# Altium schematic sheet CoinCraftA1.SchDoc (part 1 of 2)
size A0
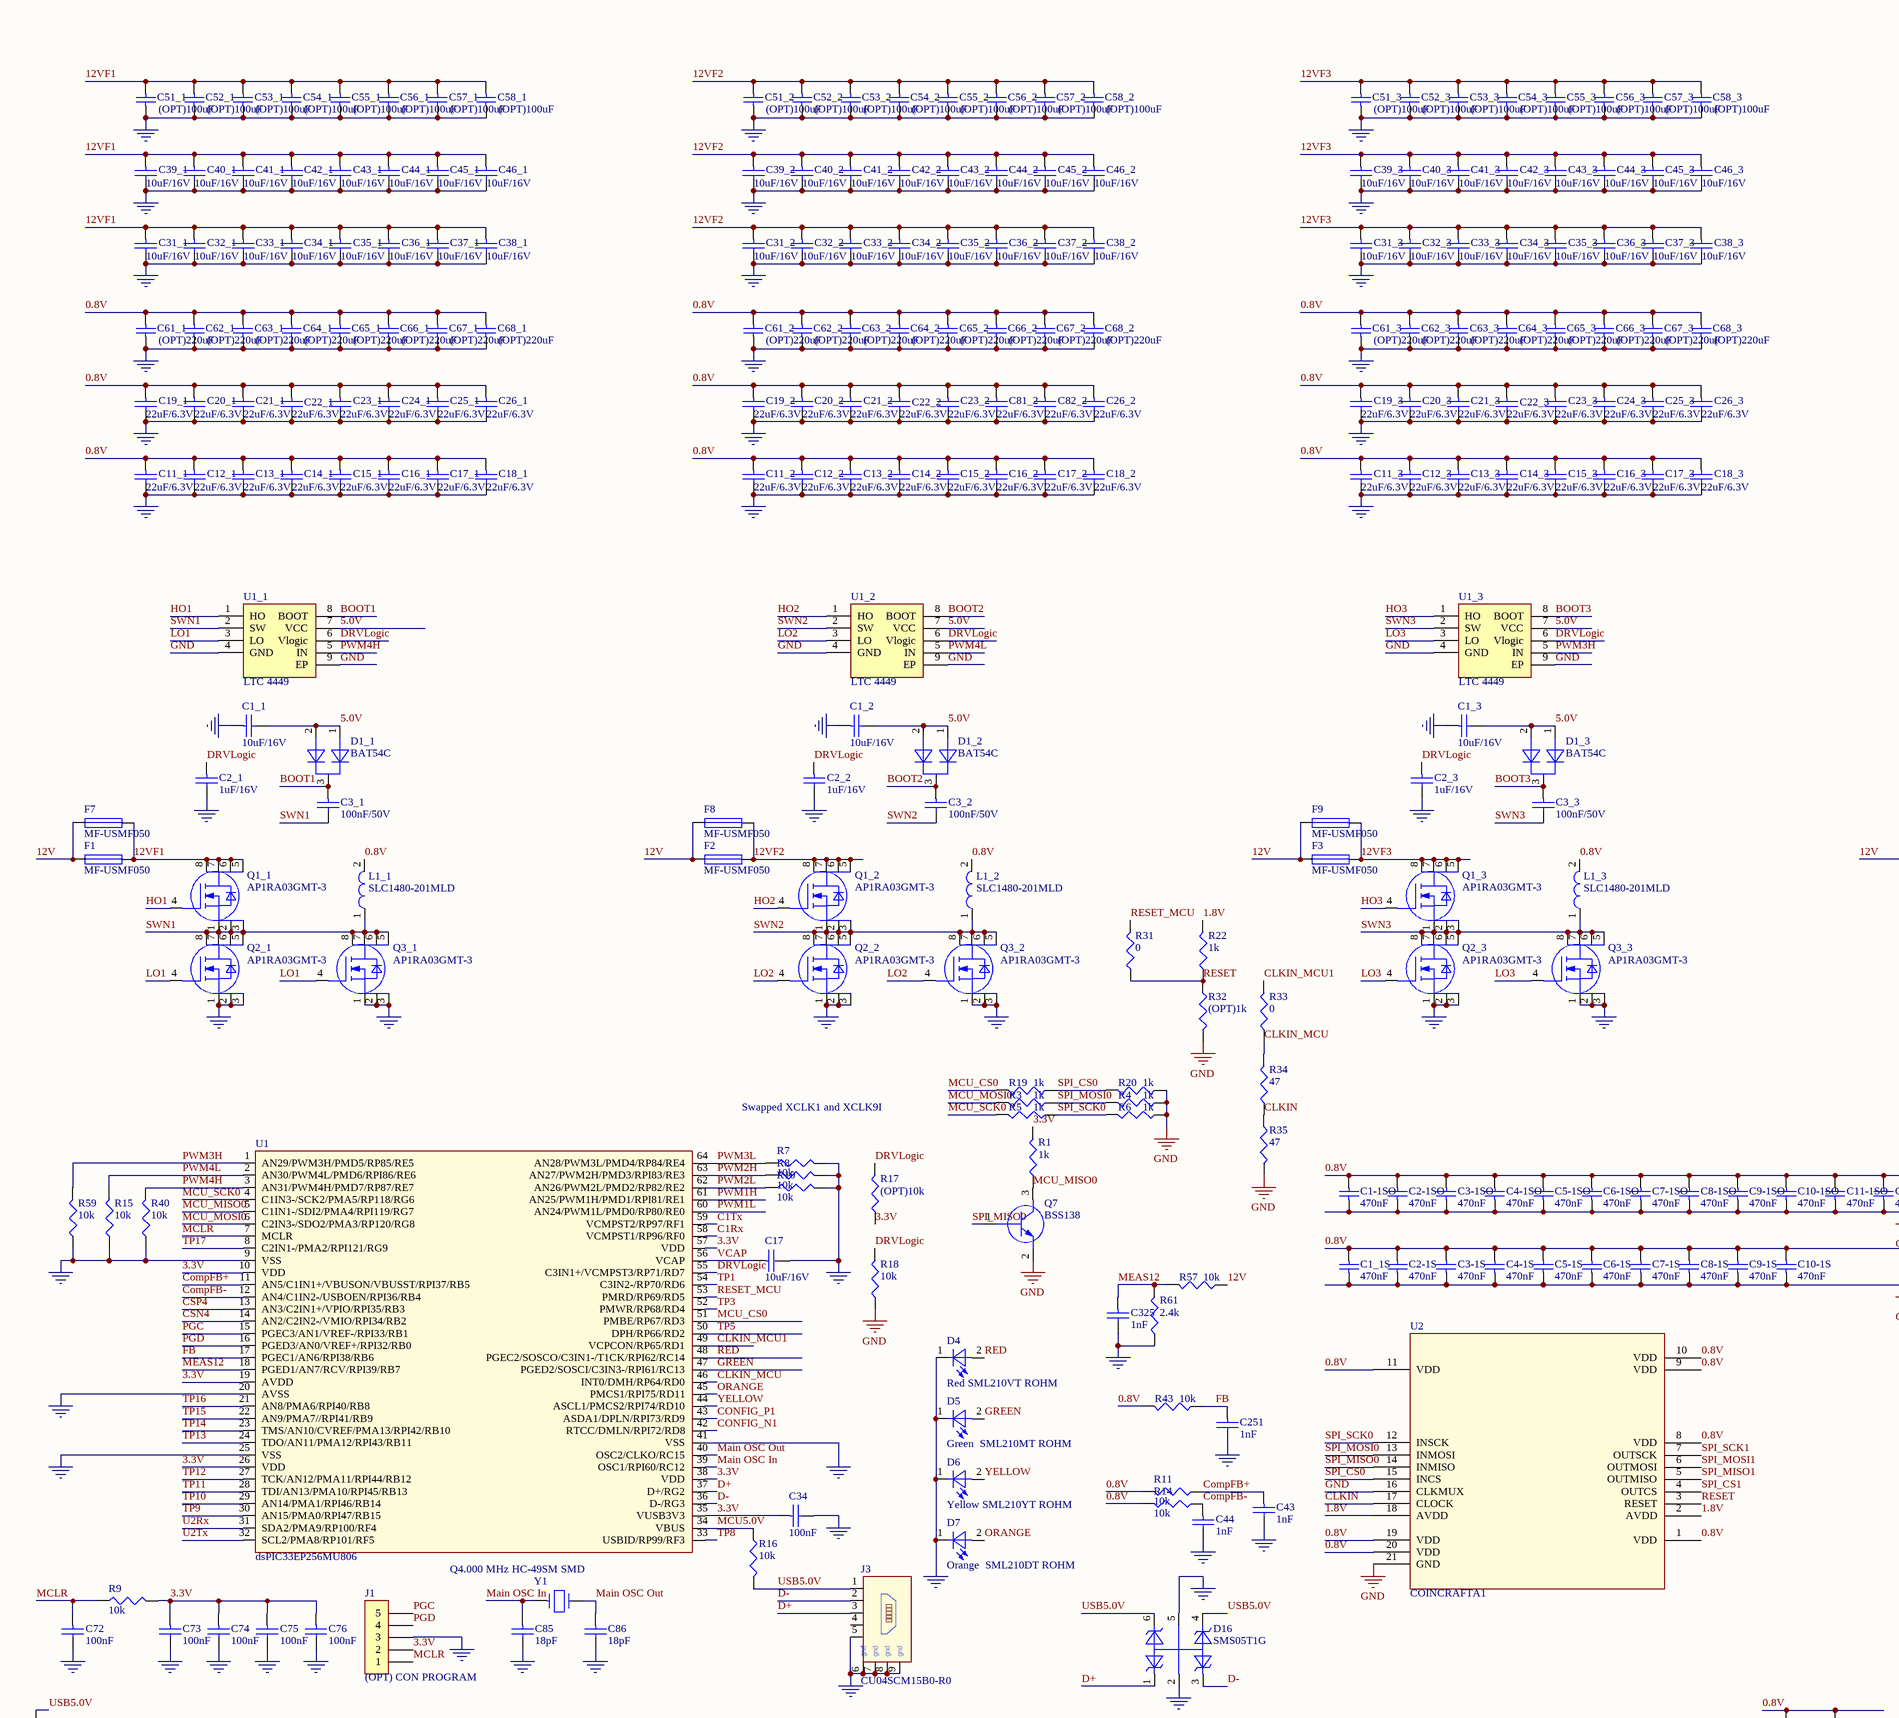
[diagram p0: CoinCraftA1.SchDoc, top left]
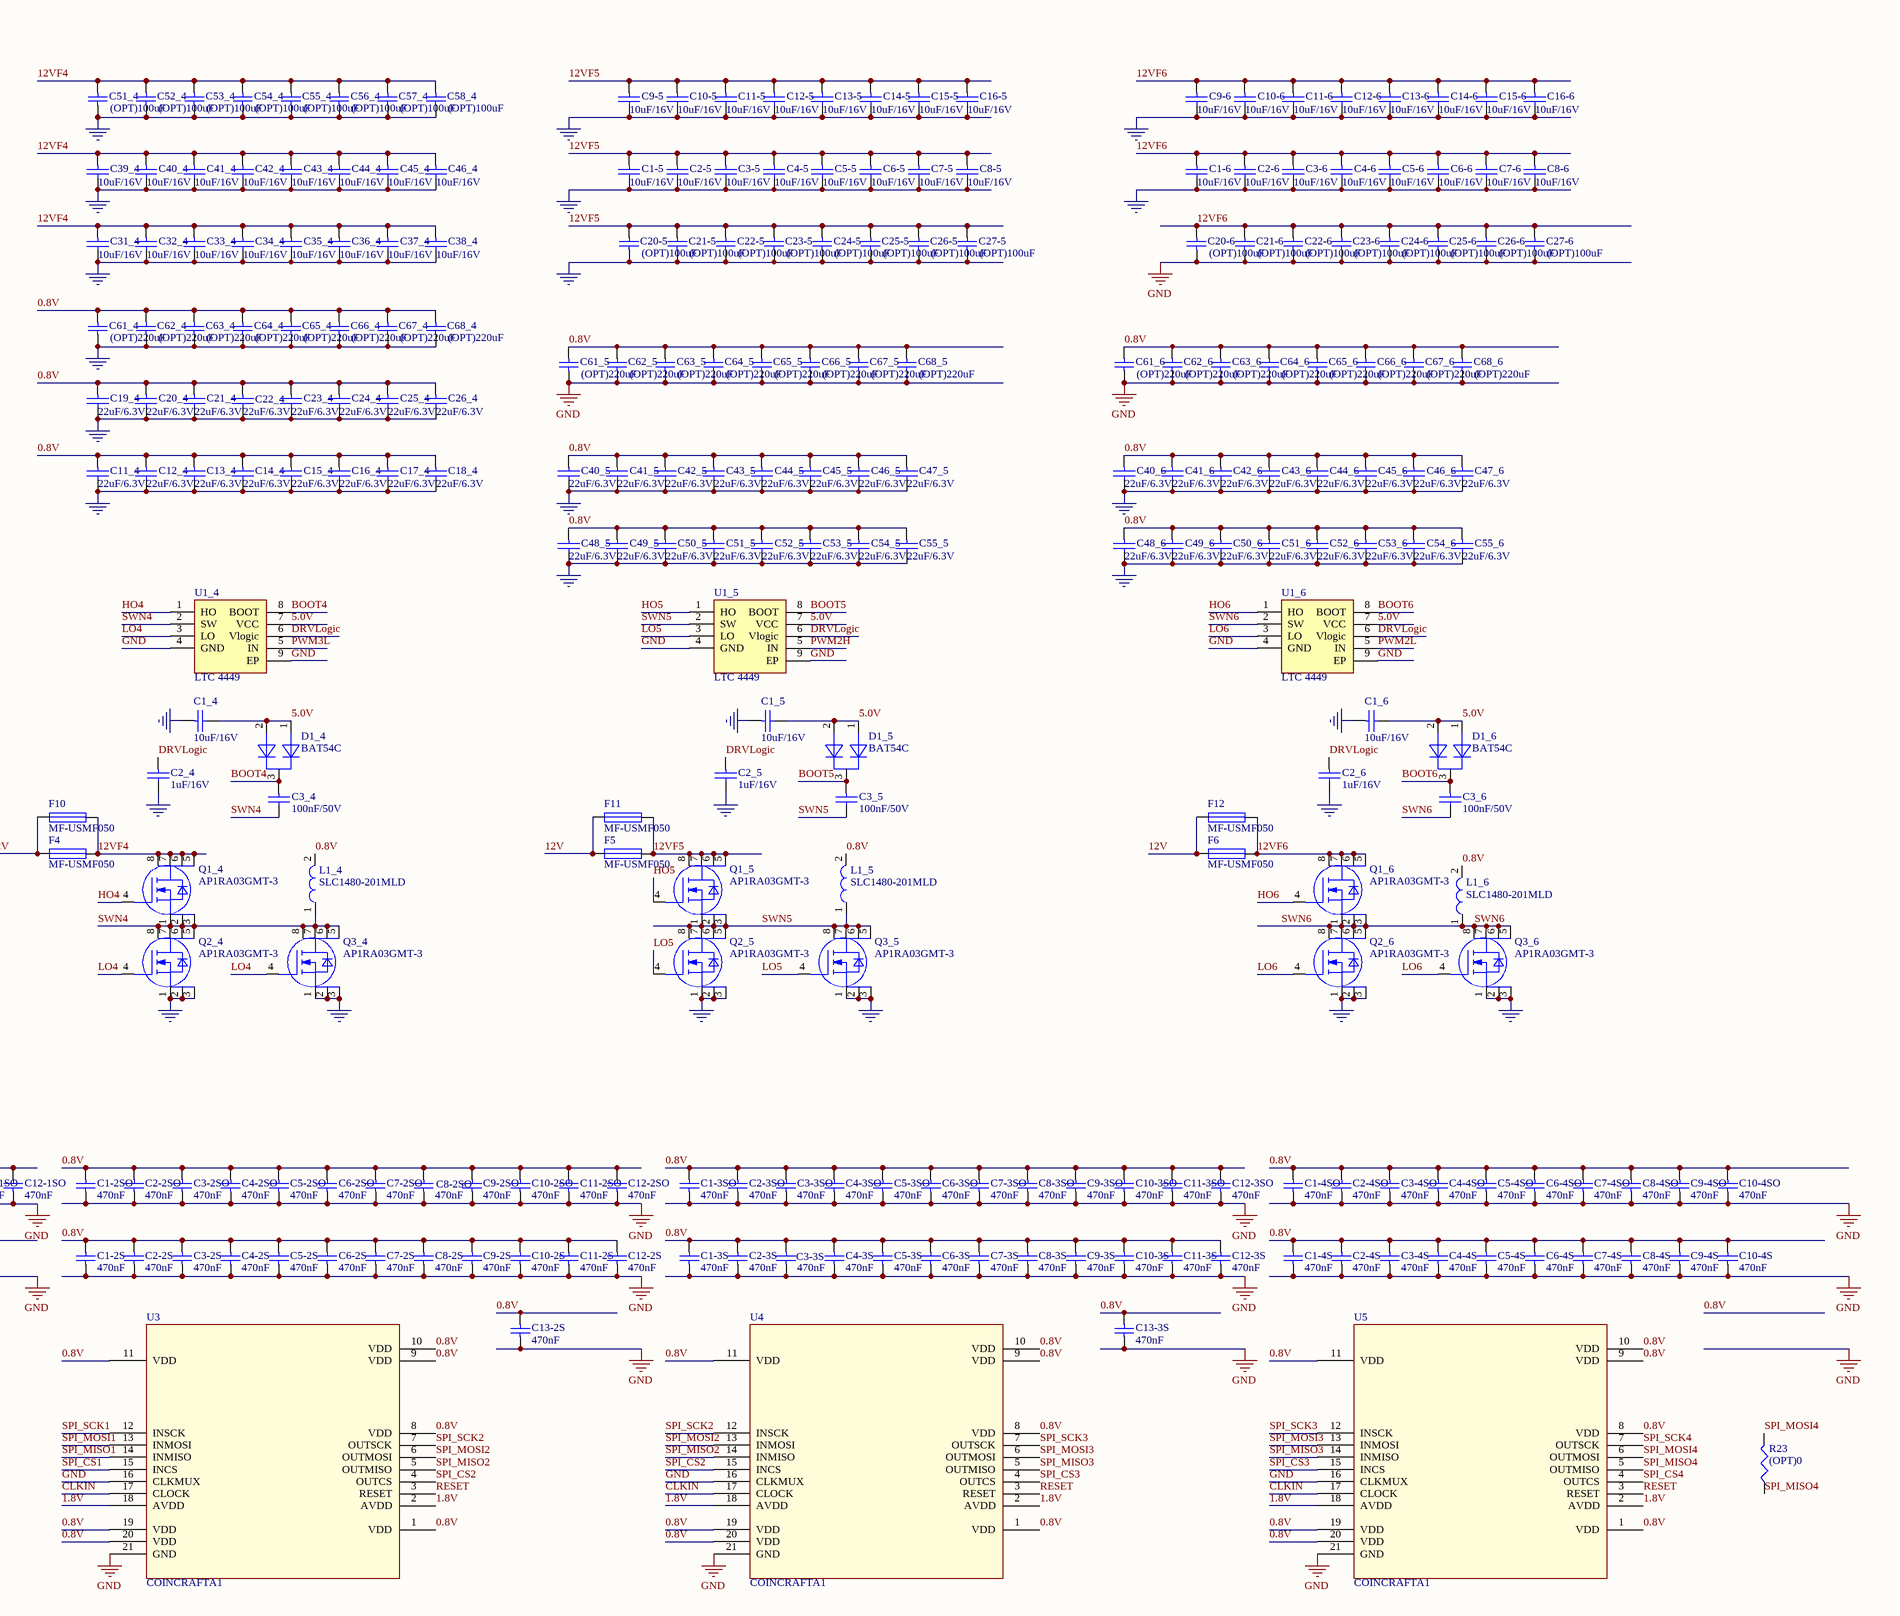
[diagram p1: CoinCraftA1.SchDoc, top middle]
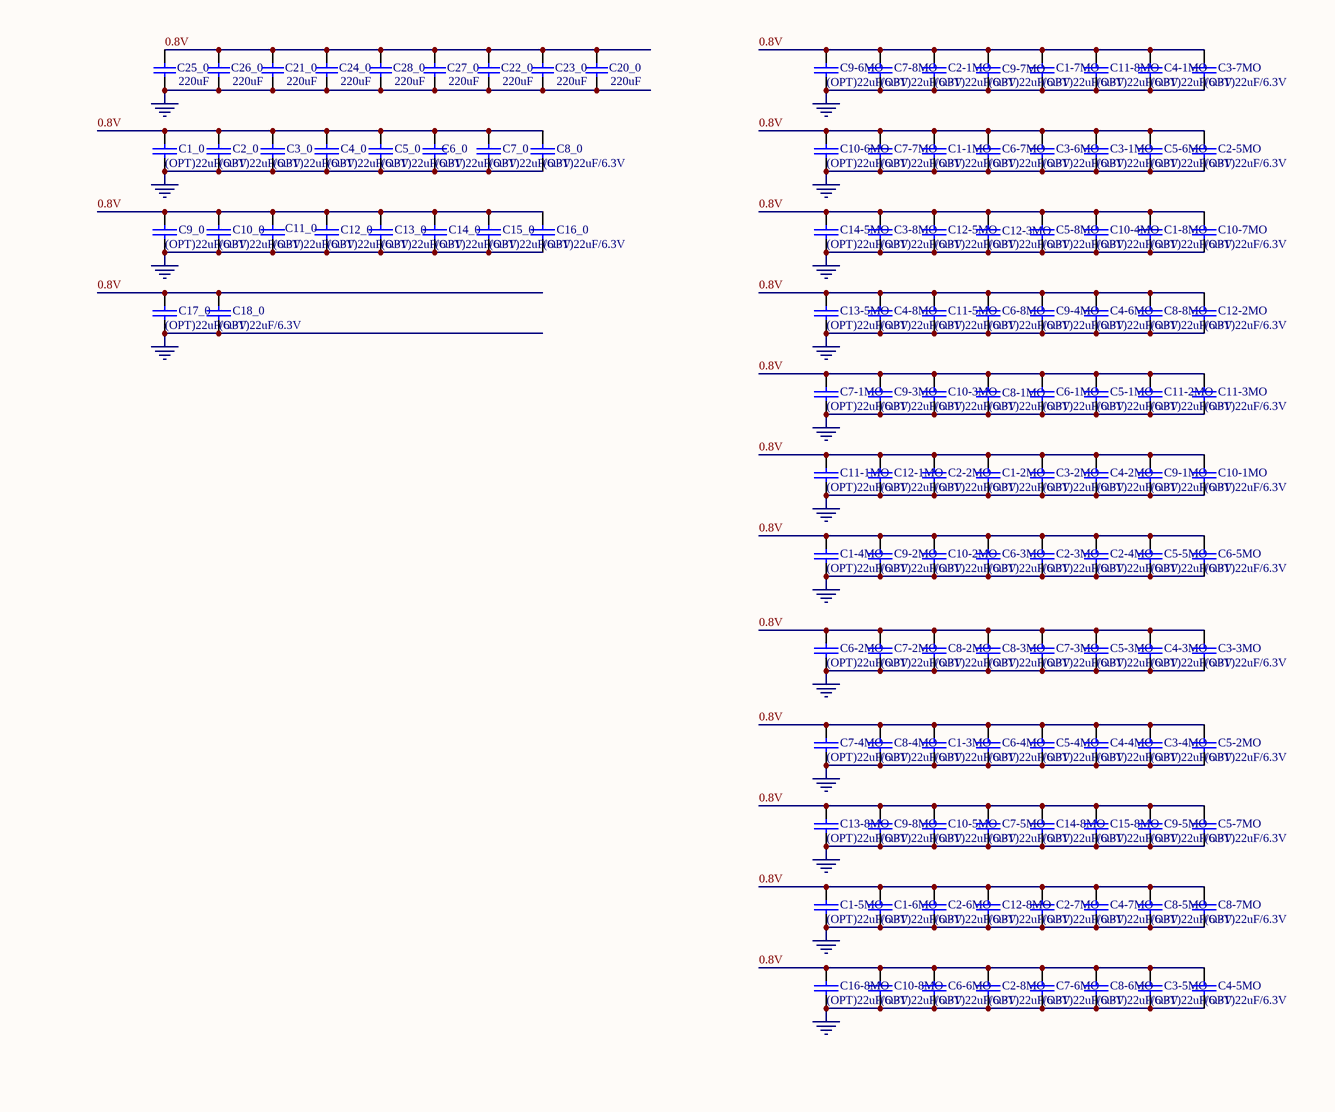
[diagram p2: CoinCraftA1.SchDoc, top right]
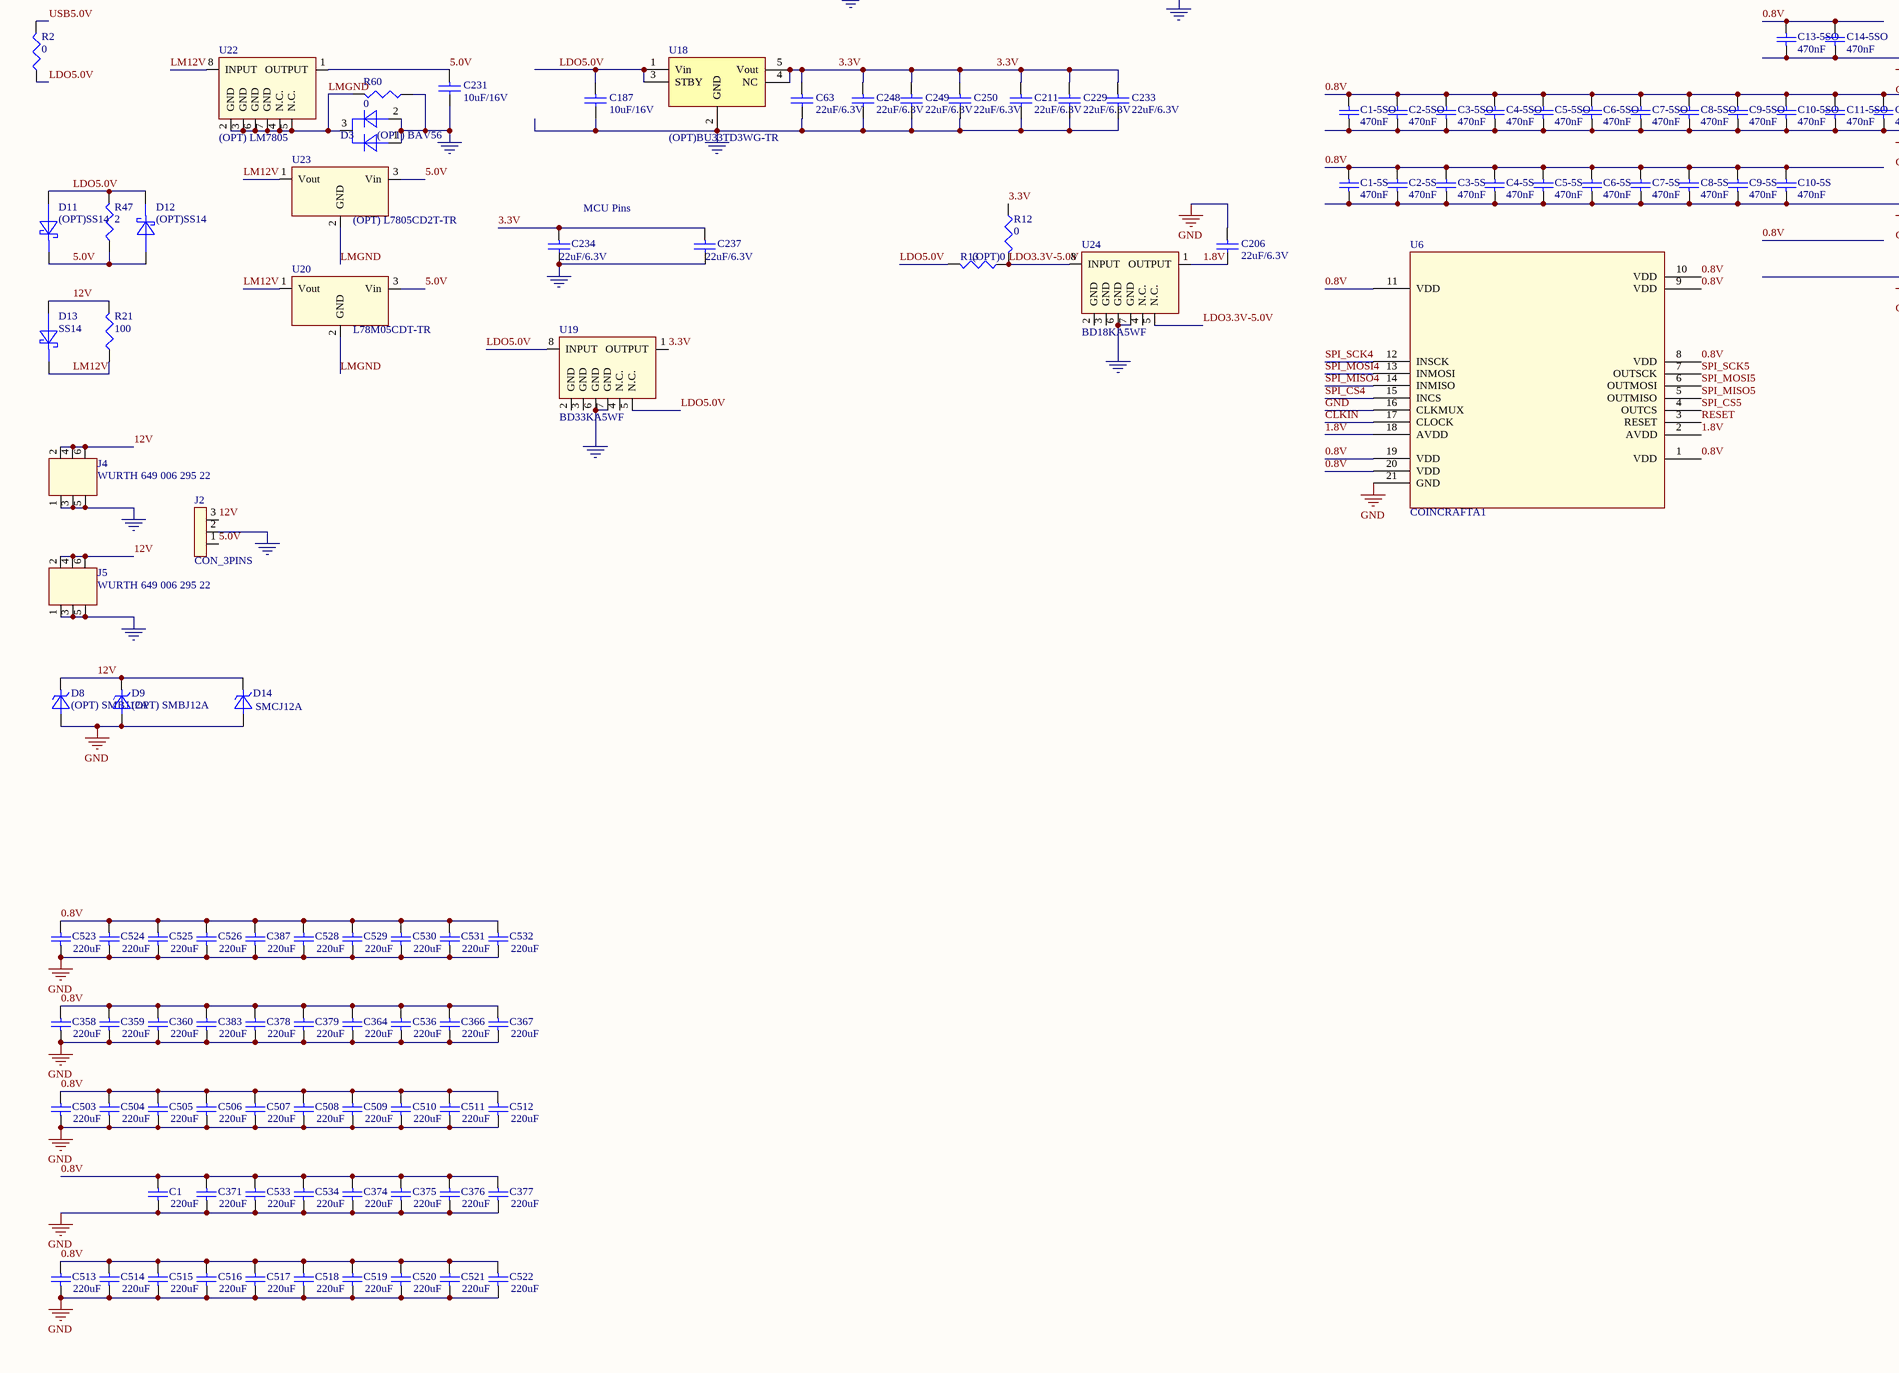
[diagram p3: CoinCraftA1.SchDoc, bottom left]
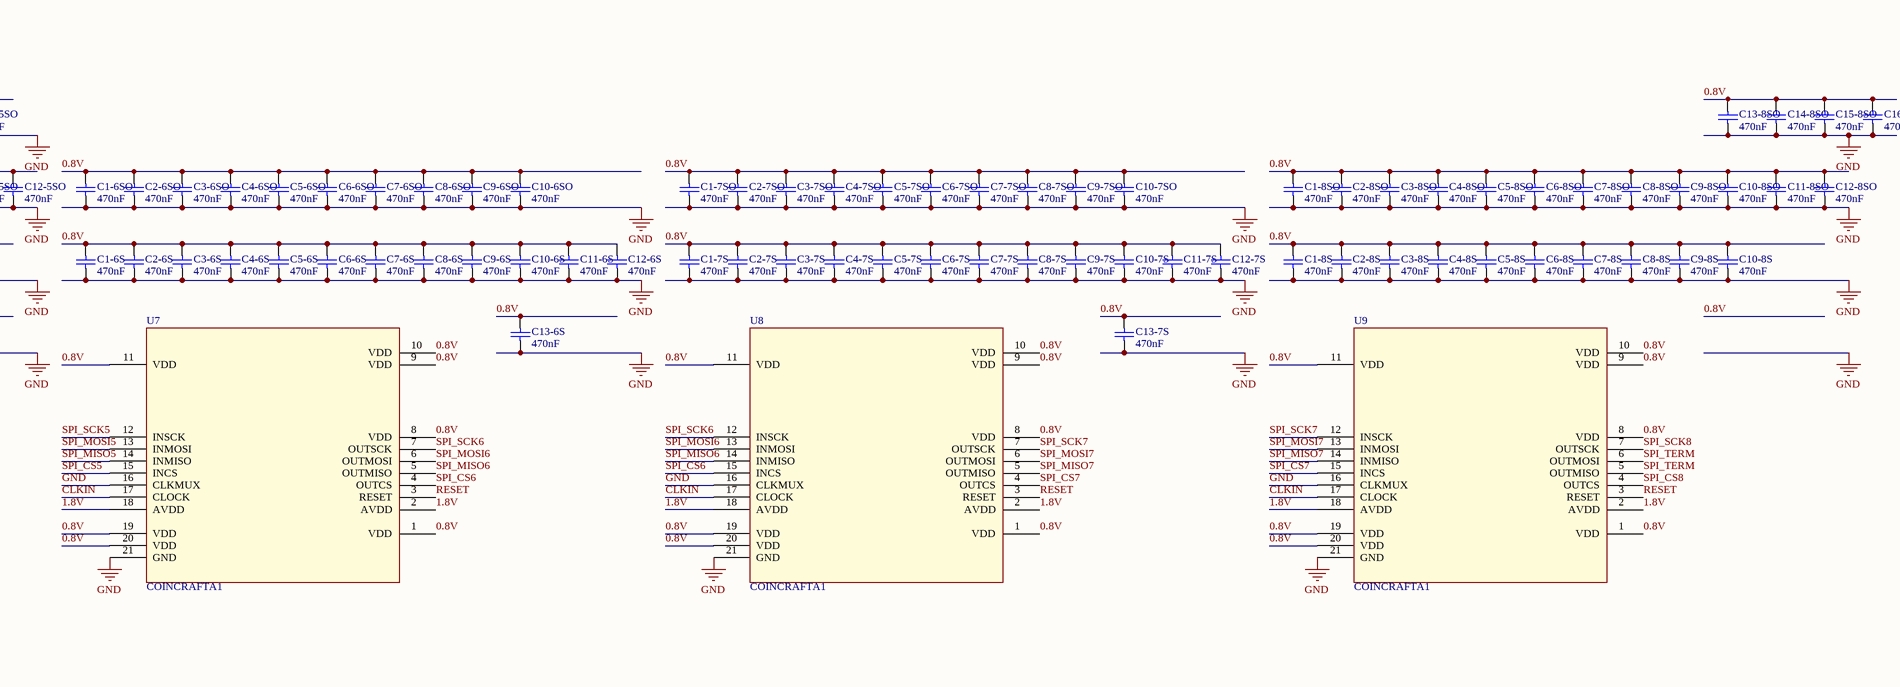
[diagram p4: CoinCraftA1.SchDoc, bottom middle]
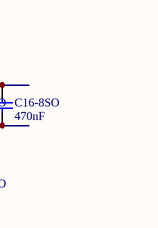
[diagram p5: CoinCraftA1.SchDoc, bottom right]

## Parts
C1  220uF  [SMD_1210_CAPC3225X279N]
C1-1MO  (OPT)22uF/6.3V  [SMD_0805_CAPC2012X145N]
C1-1SO  value 470nF  [SMD_0603_CAPC1608X80N]  (hidden comment: (OPT) 470nF)
C1-2MO  (OPT)22uF/6.3V  [SMD_0805_CAPC2012X145N]
C1-2S  470nF  [SMD_0603_CAPC1608X80N]
C1-2SO  value 470nF  [SMD_0603_CAPC1608X80N]  (hidden comment: (OPT) 470nF)
C1-3MO  (OPT)22uF/6.3V  [SMD_0805_CAPC2012X145N]
C1-3S  470nF  [SMD_0603_CAPC1608X80N]
C1-3SO  value 470nF  [SMD_0603_CAPC1608X80N]  (hidden comment: (OPT) 470nF)
C1-4MO  (OPT)22uF/6.3V  [SMD_0805_CAPC2012X145N]
C1-4S  470nF  [SMD_0603_CAPC1608X80N]
C1-4SO  value 470nF  [SMD_0603_CAPC1608X80N]  (hidden comment: (OPT) 470nF)
C1-5  10uF/16V  [SMD_0805_CAPC2012X145N]
C1-5MO  (OPT)22uF/6.3V  [SMD_0805_CAPC2012X145N]
C1-5S  470nF  [SMD_0603_CAPC1608X80N]
C1-5SO  value 470nF  [SMD_0603_CAPC1608X80N]  (hidden comment: (OPT) 470nF)
C1-6  10uF/16V  [SMD_0805_CAPC2012X145N]
C1-6MO  (OPT)22uF/6.3V  [SMD_0805_CAPC2012X145N]
C1-6S  470nF  [SMD_0603_CAPC1608X80N]
C1-6SO  value 470nF  [SMD_0603_CAPC1608X80N]  (hidden comment: (OPT) 470nF)
C1-7MO  (OPT)22uF/6.3V  [SMD_0805_CAPC2012X145N]
C1-7S  470nF  [SMD_0603_CAPC1608X80N]
C1-7SO  value 470nF  [SMD_0603_CAPC1608X80N]  (hidden comment: (OPT) 470nF)
C1-8MO  (OPT)22uF/6.3V  [SMD_0805_CAPC2012X145N]
C1-8S  470nF  [SMD_0603_CAPC1608X80N]
C1-8SO  value 470nF  [SMD_0603_CAPC1608X80N]  (hidden comment: (OPT) 470nF)
C1_0  (OPT)22uF/6.3V  [SMD_0805_CAPC2012X145N]
C1_1  10uF/16V  [SMD_0805_CAPC2012X145N]
C1_1S  470nF  [SMD_0603_CAPC1608X80N]
C1_2  10uF/16V  [SMD_0805_CAPC2012X145N]
C1_3  10uF/16V  [SMD_0805_CAPC2012X145N]
C1_4  10uF/16V  [SMD_0805_CAPC2012X145N]
C1_5  10uF/16V  [SMD_0805_CAPC2012X145N]
C1_6  10uF/16V  [SMD_0805_CAPC2012X145N]
C2-1MO  (OPT)22uF/6.3V  [SMD_0805_CAPC2012X145N]
C2-1S  470nF  [SMD_0603_CAPC1608X80N]
C2-1SO  value 470nF  [SMD_0603_CAPC1608X80N]  (hidden comment: (OPT) 470nF)
C2-2MO  (OPT)22uF/6.3V  [SMD_0805_CAPC2012X145N]
C2-2S  470nF  [SMD_0603_CAPC1608X80N]
C2-2SO  value 470nF  [SMD_0603_CAPC1608X80N]  (hidden comment: (OPT) 470nF)
C2-3MO  (OPT)22uF/6.3V  [SMD_0805_CAPC2012X145N]
C2-3S  470nF  [SMD_0603_CAPC1608X80N]
C2-3SO  value 470nF  [SMD_0603_CAPC1608X80N]  (hidden comment: (OPT) 470nF)
C2-4MO  (OPT)22uF/6.3V  [SMD_0805_CAPC2012X145N]
C2-4S  470nF  [SMD_0603_CAPC1608X80N]
C2-4SO  value 470nF  [SMD_0603_CAPC1608X80N]  (hidden comment: (OPT) 470nF)
C2-5  10uF/16V  [SMD_0805_CAPC2012X145N]
C2-5MO  (OPT)22uF/6.3V  [SMD_0805_CAPC2012X145N]
C2-5S  470nF  [SMD_0603_CAPC1608X80N]
C2-5SO  value 470nF  [SMD_0603_CAPC1608X80N]  (hidden comment: (OPT) 470nF)
C2-6  10uF/16V  [SMD_0805_CAPC2012X145N]
C2-6MO  (OPT)22uF/6.3V  [SMD_0805_CAPC2012X145N]
C2-6S  470nF  [SMD_0603_CAPC1608X80N]
C2-6SO  value 470nF  [SMD_0603_CAPC1608X80N]  (hidden comment: (OPT) 470nF)
C2-7MO  (OPT)22uF/6.3V  [SMD_0805_CAPC2012X145N]
C2-7S  470nF  [SMD_0603_CAPC1608X80N]
C2-7SO  value 470nF  [SMD_0603_CAPC1608X80N]  (hidden comment: (OPT) 470nF)
C2-8MO  (OPT)22uF/6.3V  [SMD_0805_CAPC2012X145N]
C2-8S  470nF  [SMD_0603_CAPC1608X80N]
C2-8SO  value 470nF  [SMD_0603_CAPC1608X80N]  (hidden comment: (OPT) 470nF)
C2_0  (OPT)22uF/6.3V  [SMD_0805_CAPC2012X145N]
C2_1  1uF/16V  [SMD_0805_CAPC2012X145N]
C2_2  1uF/16V  [SMD_0805_CAPC2012X145N]
C2_3  1uF/16V  [SMD_0805_CAPC2012X145N]
C2_4  1uF/16V  [SMD_0805_CAPC2012X145N]
C2_5  1uF/16V  [SMD_0805_CAPC2012X145N]
C2_6  1uF/16V  [SMD_0805_CAPC2012X145N]
C3-1MO  (OPT)22uF/6.3V  [SMD_0805_CAPC2012X145N]
C3-1S  470nF  [SMD_0603_CAPC1608X80N]
C3-1SO  value 470nF  [SMD_0603_CAPC1608X80N]  (hidden comment: (OPT) 470nF)
C3-2MO  (OPT)22uF/6.3V  [SMD_0805_CAPC2012X145N]
C3-2S  470nF  [SMD_0603_CAPC1608X80N]
C3-2SO  value 470nF  [SMD_0603_CAPC1608X80N]  (hidden comment: (OPT) 470nF)
C3-3MO  (OPT)22uF/6.3V  [SMD_0805_CAPC2012X145N]
C3-3S  470nF  [SMD_0603_CAPC1608X80N]
C3-3SO  value 470nF  [SMD_0603_CAPC1608X80N]  (hidden comment: (OPT) 470nF)
C3-4MO  (OPT)22uF/6.3V  [SMD_0805_CAPC2012X145N]
C3-4S  470nF  [SMD_0603_CAPC1608X80N]
C3-4SO  value 470nF  [SMD_0603_CAPC1608X80N]  (hidden comment: (OPT) 470nF)
C3-5  10uF/16V  [SMD_0805_CAPC2012X145N]
C3-5MO  (OPT)22uF/6.3V  [SMD_0805_CAPC2012X145N]
C3-5S  470nF  [SMD_0603_CAPC1608X80N]
C3-5SO  value 470nF  [SMD_0603_CAPC1608X80N]  (hidden comment: (OPT) 470nF)
C3-6  10uF/16V  [SMD_0805_CAPC2012X145N]
C3-6MO  (OPT)22uF/6.3V  [SMD_0805_CAPC2012X145N]
C3-6S  470nF  [SMD_0603_CAPC1608X80N]
C3-6SO  value 470nF  [SMD_0603_CAPC1608X80N]  (hidden comment: (OPT) 470nF)
C3-7MO  (OPT)22uF/6.3V  [SMD_0805_CAPC2012X145N]
C3-7S  470nF  [SMD_0603_CAPC1608X80N]
C3-7SO  value 470nF  [SMD_0603_CAPC1608X80N]  (hidden comment: (OPT) 470nF)
C3-8MO  (OPT)22uF/6.3V  [SMD_0805_CAPC2012X145N]
C3-8S  470nF  [SMD_0603_CAPC1608X80N]
C3-8SO  value 470nF  [SMD_0603_CAPC1608X80N]  (hidden comment: (OPT) 470nF)
C3_0  (OPT)22uF/6.3V  [SMD_0805_CAPC2012X145N]
C3_1  100nF/50V  [SMD_0805_CAPC2012X145N]
C3_2  100nF/50V  [SMD_0805_CAPC2012X145N]
C3_3  100nF/50V  [SMD_0805_CAPC2012X145N]
C3_4  100nF/50V  [SMD_0805_CAPC2012X145N]
C3_5  100nF/50V  [SMD_0805_CAPC2012X145N]
C3_6  100nF/50V  [SMD_0805_CAPC2012X145N]
C4-1MO  (OPT)22uF/6.3V  [SMD_0805_CAPC2012X145N]
C4-1S  470nF  [SMD_0603_CAPC1608X80N]
C4-1SO  value 470nF  [SMD_0603_CAPC1608X80N]  (hidden comment: (OPT) 470nF)
C4-2MO  (OPT)22uF/6.3V  [SMD_0805_CAPC2012X145N]
C4-2S  470nF  [SMD_0603_CAPC1608X80N]
C4-2SO  value 470nF  [SMD_0603_CAPC1608X80N]  (hidden comment: (OPT) 470nF)
C4-3MO  (OPT)22uF/6.3V  [SMD_0805_CAPC2012X145N]
C4-3S  470nF  [SMD_0603_CAPC1608X80N]
C4-3SO  value 470nF  [SMD_0603_CAPC1608X80N]  (hidden comment: (OPT) 470nF)
C4-4MO  (OPT)22uF/6.3V  [SMD_0805_CAPC2012X145N]
C4-4S  470nF  [SMD_0603_CAPC1608X80N]
C4-4SO  value 470nF  [SMD_0603_CAPC1608X80N]  (hidden comment: (OPT) 470nF)
C4-5  10uF/16V  [SMD_0805_CAPC2012X145N]
C4-5MO  (OPT)22uF/6.3V  [SMD_0805_CAPC2012X145N]
C4-5S  470nF  [SMD_0603_CAPC1608X80N]
C4-5SO  value 470nF  [SMD_0603_CAPC1608X80N]  (hidden comment: (OPT) 470nF)
C4-6  10uF/16V  [SMD_0805_CAPC2012X145N]
C4-6MO  (OPT)22uF/6.3V  [SMD_0805_CAPC2012X145N]
C4-6S  470nF  [SMD_0603_CAPC1608X80N]
C4-6SO  value 470nF  [SMD_0603_CAPC1608X80N]  (hidden comment: (OPT) 470nF)
C4-7MO  (OPT)22uF/6.3V  [SMD_0805_CAPC2012X145N]
C4-7S  470nF  [SMD_0603_CAPC1608X80N]
C4-7SO  value 470nF  [SMD_0603_CAPC1608X80N]  (hidden comment: (OPT) 470nF)
C4-8MO  (OPT)22uF/6.3V  [SMD_0805_CAPC2012X145N]
C4-8S  470nF  [SMD_0603_CAPC1608X80N]
C4-8SO  value 470nF  [SMD_0603_CAPC1608X80N]  (hidden comment: (OPT) 470nF)
C4_0  (OPT)22uF/6.3V  [SMD_0805_CAPC2012X145N]
C5-1MO  (OPT)22uF/6.3V  [SMD_0805_CAPC2012X145N]
C5-1S  470nF  [SMD_0603_CAPC1608X80N]
C5-1SO  value 470nF  [SMD_0603_CAPC1608X80N]  (hidden comment: (OPT) 470nF)
C5-2MO  (OPT)22uF/6.3V  [SMD_0805_CAPC2012X145N]
C5-2S  470nF  [SMD_0603_CAPC1608X80N]
C5-2SO  value 470nF  [SMD_0603_CAPC1608X80N]  (hidden comment: (OPT) 470nF)
C5-3MO  (OPT)22uF/6.3V  [SMD_0805_CAPC2012X145N]
C5-3S  470nF  [SMD_0603_CAPC1608X80N]
C5-3SO  value 470nF  [SMD_0603_CAPC1608X80N]  (hidden comment: (OPT) 470nF)
C5-4MO  (OPT)22uF/6.3V  [SMD_0805_CAPC2012X145N]
C5-4S  470nF  [SMD_0603_CAPC1608X80N]
C5-4SO  value 470nF  [SMD_0603_CAPC1608X80N]  (hidden comment: (OPT) 470nF)
C5-5  10uF/16V  [SMD_0805_CAPC2012X145N]
C5-5MO  (OPT)22uF/6.3V  [SMD_0805_CAPC2012X145N]
C5-5S  470nF  [SMD_0603_CAPC1608X80N]
C5-5SO  value 470nF  [SMD_0603_CAPC1608X80N]  (hidden comment: (OPT) 470nF)
C5-6  10uF/16V  [SMD_0805_CAPC2012X145N]
C5-6MO  (OPT)22uF/6.3V  [SMD_0805_CAPC2012X145N]
C5-6S  470nF  [SMD_0603_CAPC1608X80N]
C5-6SO  value 470nF  [SMD_0603_CAPC1608X80N]  (hidden comment: (OPT) 470nF)
C5-7MO  (OPT)22uF/6.3V  [SMD_0805_CAPC2012X145N]
C5-7S  470nF  [SMD_0603_CAPC1608X80N]
C5-7SO  value 470nF  [SMD_0603_CAPC1608X80N]  (hidden comment: (OPT) 470nF)
C5-8MO  (OPT)22uF/6.3V  [SMD_0805_CAPC2012X145N]
C5-8S  470nF  [SMD_0603_CAPC1608X80N]
C5-8SO  value 470nF  [SMD_0603_CAPC1608X80N]  (hidden comment: (OPT) 470nF)
C5_0  (OPT)22uF/6.3V  [SMD_0805_CAPC2012X145N]
C6-1MO  (OPT)22uF/6.3V  [SMD_0805_CAPC2012X145N]
C6-1S  470nF  [SMD_0603_CAPC1608X80N]
C6-1SO  value 470nF  [SMD_0603_CAPC1608X80N]  (hidden comment: (OPT) 470nF)
C6-2MO  (OPT)22uF/6.3V  [SMD_0805_CAPC2012X145N]
C6-2S  470nF  [SMD_0603_CAPC1608X80N]
C6-2SO  value 470nF  [SMD_0603_CAPC1608X80N]  (hidden comment: (OPT) 470nF)
C6-3MO  (OPT)22uF/6.3V  [SMD_0805_CAPC2012X145N]
C6-3S  470nF  [SMD_0603_CAPC1608X80N]